# EasyEDA Pro project ca_car.eprj, board ca_pcb
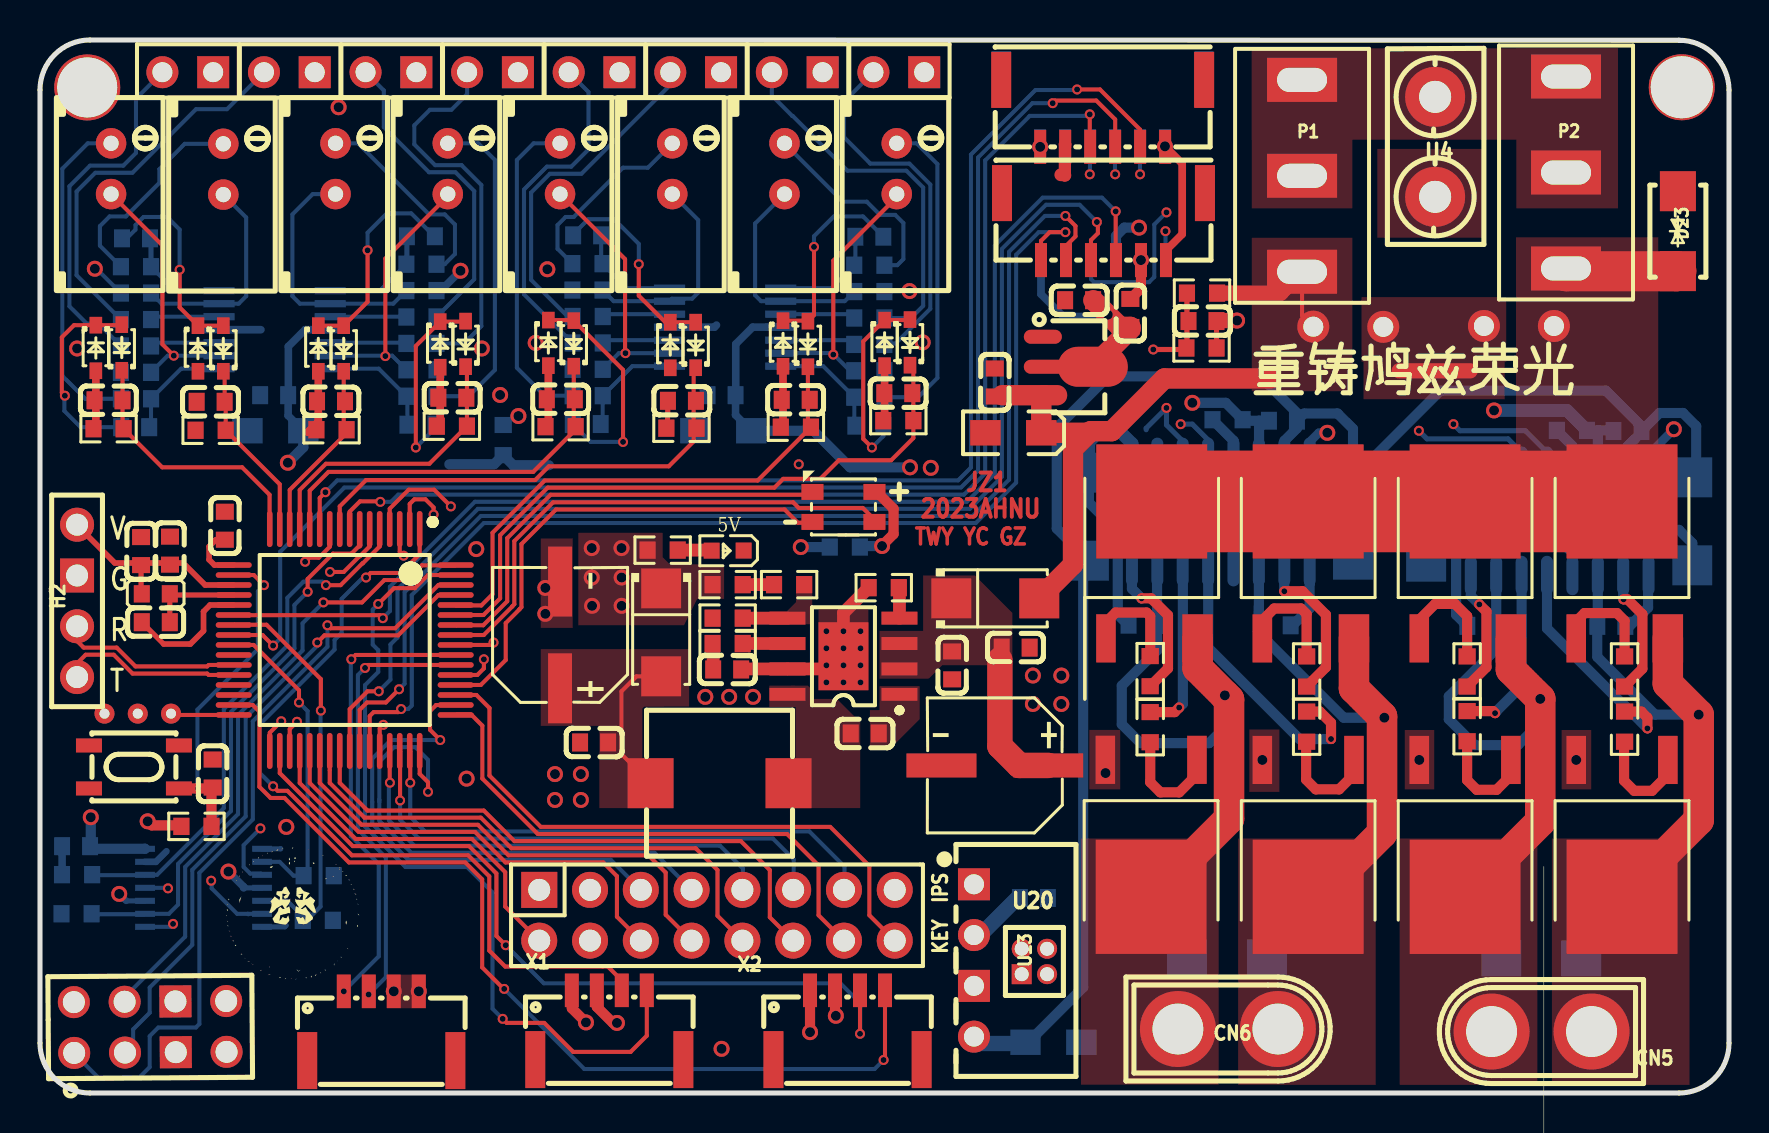
[diagram p0: board, top side]
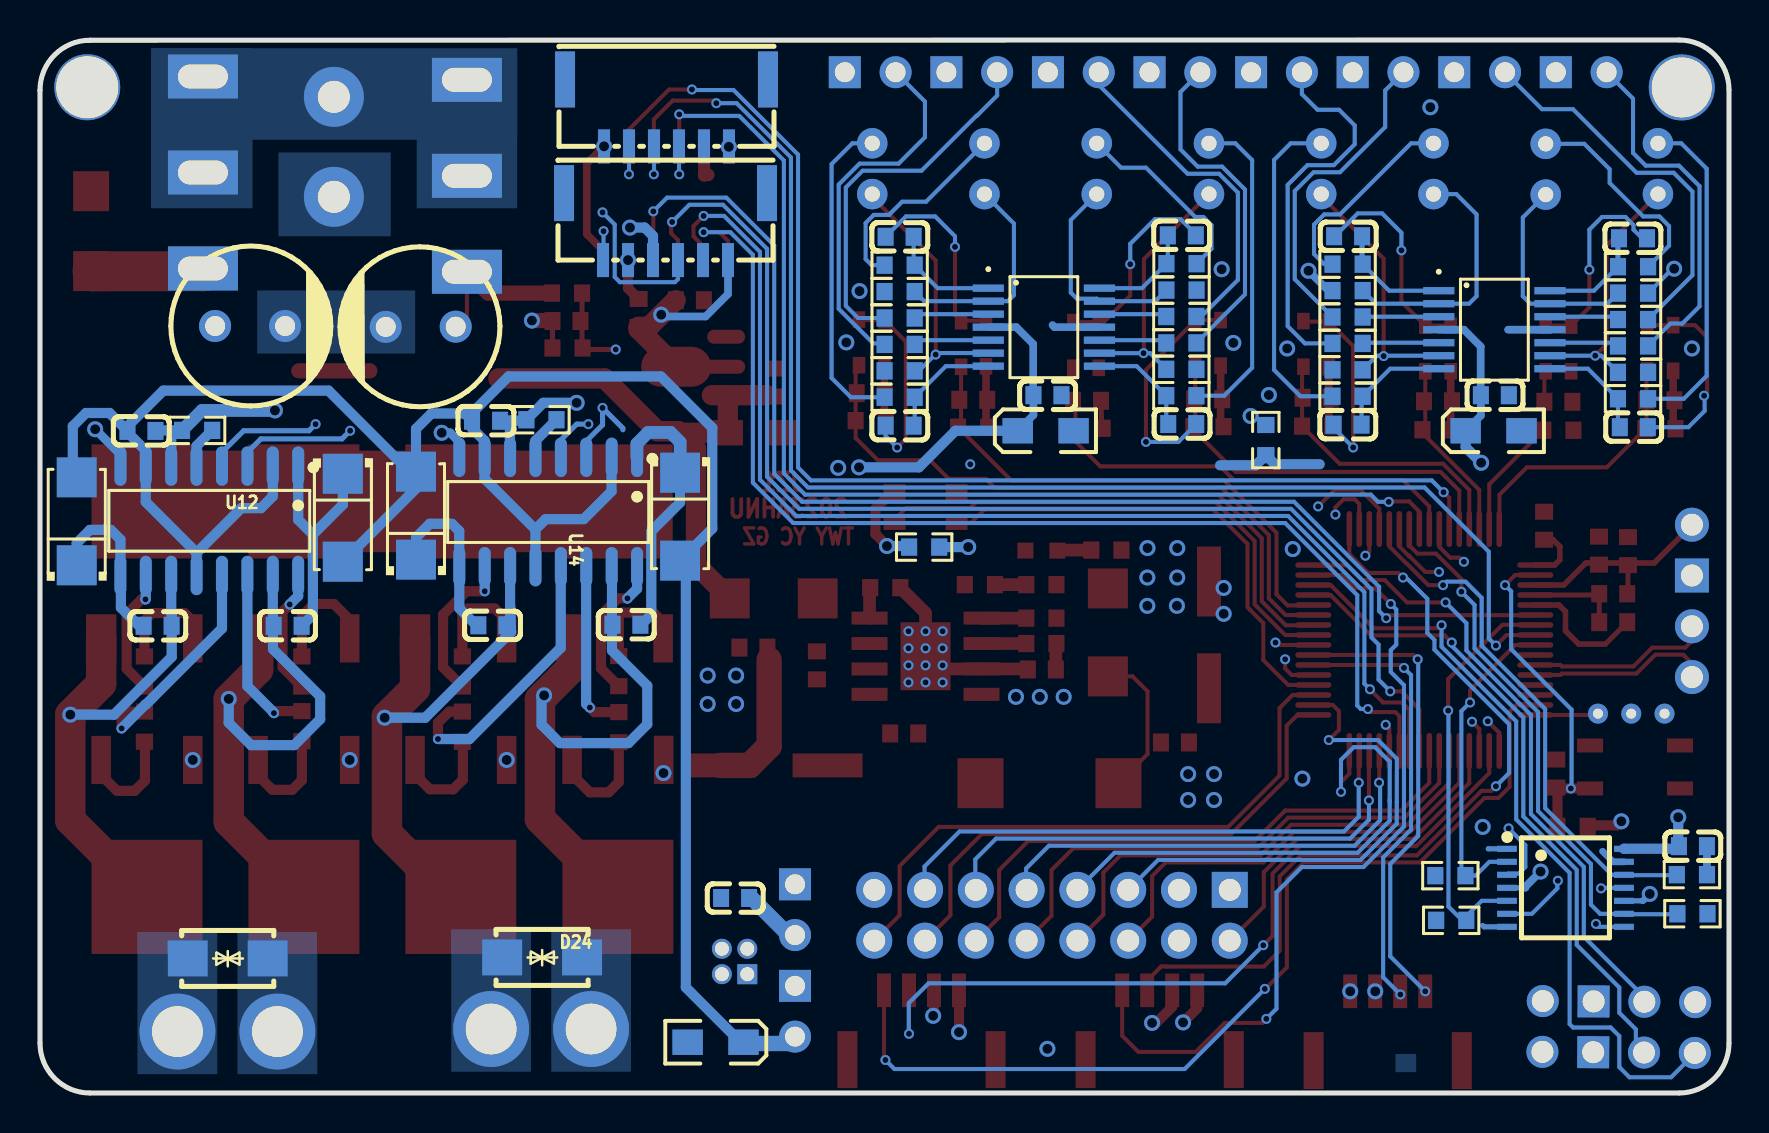
[diagram p1: board, bottom side, seen from below]

Outline 84.47 x 52.67 mm; copper layers: Top Layer, 地1, 信号, 电源, 地2, Bottom Layer. Coordinates in mm from the lower left corner of the outline.
Outline path: 0,50.17 0,2.5 arc(0.73,0.73) 2.5,0 81.97,0 arc(83.74,0.73) 84.47,2.5 84.47,50.15 arc(83.74,51.92) 81.97,52.65 2.5,52.67 arc(0.73,51.93) 0,50.17
Stack: Top Layer 0.035mm / Dielectric1 0.274mm PP er 4.5 / 地2 0.035mm / Dielectric2 0.274mm PP er 4.5 / 地1 0.035mm / Dielectric3 0.274mm FR4 er 4.5 / 信号 0.035mm / Dielectric4 0.274mm PP er 4.5 / 电源 0.035mm / Dielectric5 0.274mm PP er 4.5 / Bottom Layer 0.035mm

## Design rules (mm)
net RX: DP1
net TX: DP1
spacing safeClearance (default): track to track 0.152, other pairs 0 to 0.3
track width trackWidth (default): min 0.127, default 0.254, max 5.08
differential pair differentialPair (default): width min 0.127, default 0.254, max 2.54; gap min 0.152, default 0.152
via viaSize (default): diameter min 0.5, default 0.61, max 10; hole min 0.3, default 0.305, max 6

## Placement (name value [footprint] x y rotation side)
C1  -  [C0603]  14.55 34.6 0 top
C2  -  [C0603]  8.53 34.57 0 top
C3  -  [C0603]  19.05 42.85 0 bottom
C4  -  [C0603]  4.8 42.75 180 bottom
C5  -  [C0603]  58.14 38.61 0 top
C6  -  [C0603]  47.75 35.53 270 top
C7  -  [C0603]  19.08 33.43 0 bottom
C8  -  [C0603]  4.76 33.3 180 bottom
C9  -  [C0603]  11.71 34.9 0 bottom
C10  10uf钽电容  [10uf]  11.79 33.38 180 bottom
C11  -  [C0603]  20.62 34.77 0 top
C12  -  [C0603]  3.43 34.65 0 top
C13  -  [C0603]  41.25 17.98 180 top
C14  -  [C0603]  37.8 34.67 0 top
C15  -  [C0603]  32.11 34.62 0 top
C16  -  [C0603]  27.71 17.53 180 top
C17  100  [CAP-SMD_BD6.3-L6.6-W6.6-LS7.2-FD-1]  26.01 22.91 90 top
C18  -  [C0603]  34.09 34.9 0 bottom
C19  10uf钽电容  [10uf]  34.19 33.38 180 bottom
C20  -  [C0603]  41.48 42.82 0 bottom
C21  -  [C0603]  27.37 42.9 180 bottom
C22  100  [CAP-SMD_BD6.3-L6.6-W6.6-LS7.2-FD-1]  47.75 16.38 180 top
C23  -  [C0603]  48.79 22.28 0 top
C24  -  [C0603]  45.62 21.39 270 top
C25  -  [C0603]  34.37 21.18 180 top
C26  -  [C0603]  41.48 33.38 0 bottom
C27  -  [C0603]  27.35 33.46 180 bottom
C28  -  [C0603]  42.93 35 0 top
C29  -  [C0603]  26.05 34.7 0 top
C30  -  [C0603]  1.8 12.34 180 bottom
C31  -  [C0603]  72.09 23.37 180 bottom
C32  -  [C0603]  78.59 23.37 0 bottom
C33  -  [C0603]  79.4 33.11 180 bottom
C34  10uf钽电容  [10uf]  50.67 2.29 0 bottom
C35  100nF  [C0603]  49.71 9.75 0 bottom
C36  -  [C0603]  55.14 23.42 180 bottom
C37  -  [C0603]  51.97 39.65 180 top
C38  -  [C0603]  61.85 23.39 0 bottom
C39  -  [C0603]  62.16 33.62 180 bottom
C40  -  [C0603]  9.25 28.37 270 top
C41  -  [C0603]  8.64 15.98 90 top
C42  -  [C0603]  5.79 23.55 0 top
C43  -  [C0603]  5.05 27.1 90 top
C44  -  [C0603]  6.5 27.13 90 top
C45  470u  [KY-电解电容直径8]  65.43 38.32 359.9 bottom
C46  470u  [KY-电解电容直径8]  73.97 38.36 180 bottom
C47  10uf钽电容  [10uf]  48.69 32.77 180 top
C48  -  [C0603]  54.53 39.01 90 top
CN1  A1257WV-S-6P  [CONN-SMD_A1257WV-S-6P]  53.15 49 180 top
CN2  A1257WV-S-6P  [CONN-SMD_A1257WV-S-6P]  53.19 43.33 180 top
CN3  A1257WV-S-6P  [CONN-SMD_A1257WV-S-6P]  53.19 43.33 0 bottom
CN4  A1257WV-S-6P  [CONN-SMD_A1257WV-S-6P]  53.14 49.02 0 bottom
CN5  XT30U-M  [CONN-TH_XT30U-M]  75.1 3.07 180 top
CN6  XT30U-M  [CONN-TH_XT30U-M]  59.41 3.2 0 top
D1  1N5819WS S4  [SOD-323_L1.7-W1.3-LS2.6-RD-1]  15.19 37.24 90 top
D2  1N5819WS S4  [SOD-323_L1.7-W1.3-LS2.6-RD-1]  9.17 37.24 90 top
D3  1N5819WS S4  [SOD-323_L1.7-W1.3-LS2.6-RD-1]  13.92 37.24 270 top
D4  1N5819WS S4  [SOD-323_L1.7-W1.3-LS2.6-RD-1]  7.9 37.24 270 top
D5  1N5819WS S4  [SOD-323_L1.7-W1.3-LS2.6-RD-1]  20.02 37.44 270 top
D6  1N5819WS S4  [SOD-323_L1.7-W1.3-LS2.6-RD-1]  2.79 37.26 270 top
D7  1N5819WS S4  [SOD-323_L1.7-W1.3-LS2.6-RD-1]  21.29 37.47 90 top
D8  1N5819WS S4  [SOD-323_L1.7-W1.3-LS2.6-RD-1]  4.09 37.29 90 top
D9  ss54  [SMA_L4.3-W2.6-LS5.1-RD]  31.06 23.04 270 top
D10  ss54  [SMA_L4.3-W2.6-LS5.1-RD]  47.78 24.74 0 top
D11  1N5819WS S4  [SOD-323_L1.7-W1.3-LS2.6-RD-1]  38.41 37.46 90 top
D12  1N5819WS S4  [SOD-323_L1.7-W1.3-LS2.6-RD-1]  32.79 37.41 90 top
D13  1N5819WS S4  [SOD-323_L1.7-W1.3-LS2.6-RD-1]  37.16 37.49 270 top
D14  1N5819WS S4  [SOD-323_L1.7-W1.3-LS2.6-RD-1]  31.52 37.41 270 top
D15  1N5819WS S4  [SOD-323_L1.7-W1.3-LS2.6-RD-1]  42.24 37.52 270 top
D16  1N5819WS S4  [SOD-323_L1.7-W1.3-LS2.6-RD-1]  25.43 37.52 270 top
D17  1N5819WS S4  [SOD-323_L1.7-W1.3-LS2.6-RD-1]  43.51 37.54 90 top
D18  1N5819WS S4  [SOD-323_L1.7-W1.3-LS2.6-RD-1]  26.7 37.49 90 top
D19  SS14  [SMA_L4.3-W2.6-LS5.1-RD]  69.32 28.77 270 bottom
D20  -  [SMA_L4.3-W2.5-LS5.0-BI]  75.08 6.73 0 bottom
D21  SS14  [SMA_L4.3-W2.6-LS5.1-RD]  82.63 28.59 90 bottom
D22  SS14  [SMA_L4.3-W2.6-LS5.1-RD]  52.46 28.82 270 bottom
D23  -  [SMA_L4.3-W2.5-LS5.0-BI]  81.91 43.1 90 top
D24  -  [SMA_L4.3-W2.5-LS5.0-BI]  59.36 6.78 0 bottom
D25  SS14  [SMA_L4.3-W2.6-LS5.1-RD]  65.67 28.87 90 bottom
H2  -  [HDR-TH_4P-P2.54-V-F]  1.85 24.61 270 top
H3  -  [HDR-TH_16P-P2.54-V-F]  25.17 51.05 0 top
H4  -  [HDR-TH_8P-P2.54-V-F-R2-C4-S2.54-1]  5.51 3.3 0.4 top
K1  -  [按键]  4.7 18.09 180 top
L1  4,7uh  [IND-SMD_L7.3-W7.3]  33.99 15.49 180 top
LED1  LTST-N683EGBW  [LED-SMD_4P-L3.2-W2.8-P1.50-LS3.5-TL_LTST-N683EGBW]  40.18 29.31 0 top
LED2  -  [LED0603-RD_BLUE]  34.39 27.13 180 top
NOREF  -  [Pad_e1501]  82.11 50.3 270 top
NOREF#2  -  [Pad_e3658]  6.55 18.97 0 top
NOREF#3  -  [Pad_e8166]  4.89 18.97 0 top
NOREF#4  -  [Pad_e1499]  2.36 50.29 0 top
NOREF#5  -  [Pad_e8167]  3.23 18.97 0 top
P1  -  [扭子开关]  63.05 46.02 180 top
P2  -  [扭子开关]  76.39 45.89 0 top
Q1  LR7843  [TO-252-2_L6.6-W6.1-P4.58-LS9.9-BR]  71.27 26.16 270 top
Q2  LR7843  [TO-252-2_L6.6-W6.1-P4.58-LS9.9-BR]  79.12 26.16 270 top
Q3  LR7843  [TO-252-2_L6.6-W6.1-P4.58-LS9.9-BR#2]  71.27 13.23 90 top
Q4  LR7843  [TO-252-2_L6.6-W6.1-P4.58-LS9.9-BR#2]  79.12 13.23 90 top
Q5  LR7843  [TO-252-2_L6.6-W6.1-P4.58-LS9.9-BR]  55.6 26.16 270 top
Q6  LR7843  [TO-252-2_L6.6-W6.1-P4.58-LS9.9-BR]  63.42 26.16 270 top
Q7  LR7843  [TO-252-2_L6.6-W6.1-P4.58-LS9.9-BR#2]  55.57 13.24 90 top
Q8  LR7843  [TO-252-2_L6.6-W6.1-P4.58-LS9.9-BR#2]  63.42 13.23 90 top
R1  -  [R0603]  14.58 33.17 0 top
R2  -  [R0603]  8.53 33.15 0 top
R3  -  [R0603]  19.08 41.45 180 bottom
R4  -  [R0603]  4.8 41.33 0 bottom
R5  -  [R0603]  19.08 40.13 0 bottom
R6  -  [R0603]  19.08 38.81 0 bottom
R7  -  [R0603]  4.8 38.68 180 bottom
R8  -  [R0603]  4.8 40.01 180 bottom
R10  -  [R0603]  58.12 40.01 180 top
R11  -  [R0603]  58.09 37.26 0 top
R12  -  [R0603]  19.08 36.17 0 bottom
R13  -  [R0603]  19.08 37.49 0 bottom
R14  -  [R0603]  4.8 37.36 180 bottom
R15  -  [R0603]  4.8 36.04 180 bottom
R16  -  [R0603]  19.08 34.85 180 bottom
R17  -  [R0603]  4.8 34.72 0 bottom
R18  -  [R0603]  20.6 33.35 0 top
R19  -  [R0603]  3.43 33.22 0 top
R20  -  [R0603]  40.25 27.31 180 bottom
R21  -  [R0603]  34.39 25.43 0 top
R22  -  [R0603]  31.14 27.15 0 top
R23  -  [R0603]  37.8 33.3 0 top
R24  -  [R0603]  32.08 33.25 0 top
R25  -  [R0603]  37.47 25.43 0 top
R26  -  [R0603]  41.48 41.4 180 bottom
R27  -  [R0603]  27.38 41.48 0 bottom
R28  -  [R0603]  42.2 25.27 0 top
R29  10K  [R0603]  34.39 23.75 180 top
R30  -  [R0603]  34.39 22.48 0 top
R31  -  [R0603]  41.48 40.08 0 bottom
R32  -  [R0603]  41.48 38.76 0 bottom
R33  -  [R0603]  27.39 38.84 180 bottom
R34  -  [R0603]  27.38 40.16 180 bottom
R35  -  [R0603]  41.48 36.12 0 bottom
R36  -  [R0603]  41.48 37.44 0 bottom
R37  -  [R0603]  27.39 37.52 180 bottom
R38  -  [R0603]  23.17 32.66 90 bottom
R39  -  [R0603]  27.39 36.2 180 bottom
R40  -  [R0603]  41.48 34.8 180 bottom
R41  -  [R0603]  27.39 34.87 0 bottom
R42  -  [R0603]  42.93 33.63 0 top
R43  -  [R0603]  26.04 33.33 0 top
R44  -  [R0603]  71.37 21.08 90 top
R45  -  [R0603]  79.25 21.08 270 top
R46  10K  [R0603]  13.89 8.64 0 bottom
R47  10K  [R0603]  1.85 10.92 0 bottom
R48  -  [R0603]  71.37 18.35 270 top
R49  -  [R0603]  79.25 18.32 90 top
R50  10K  [R0603]  13.94 10.87 0 bottom
R51  10K  [R0603]  1.83 8.97 0 bottom
R52  10K  [R0603]  76.61 33.14 0 bottom
R53  -  [R0603]  55.52 21.1 90 top
R54  -  [R0603]  63.35 21.08 270 top
R55  -  [R0603]  55.52 18.3 270 top
R56  -  [R0603]  63.35 18.32 90 top
R57  10K  [R0603]  7.82 13.34 0 top
R58  10K  [R0603]  59.39 33.67 0 bottom
U4  -  [端子]  68.12 136.86 90 top
U5  -  [TSSOP-14_L4.9-W4.4-P0.65-LS6.4-BL]  11.73 38.18 270 bottom
U7  SP1N28STER  [SOP-8E]  40.18 21.84 180 top
U8  -  [TSSOP-14_L4.9-W4.4-P0.65-LS6.4-BL]  34.26 38.3 270 bottom
U10  -  [LQFP-64_L10.0-W10.0-P0.50-LS12.0-TL]  15.24 22.66 270 top
U11  -  [TSSOP-14_L5.0-W4.4-P0.65-LS6.5-BL]  8.18 10.26 270 bottom
U12  HIP4082IBZ  [SOIC-16_L9.9-W3.9-P1.27-LS6.0-BL]  76 28.62 0 bottom
U13  -  [PWRM-TH_BXXXXS-1W]  46.71 6.63 270 top
U14  HIP4082IBZ  [SOIC-16_L9.9-W3.9-P1.27-LS6.0-BL]  59.06 29.06 0 bottom
U17  磁珠  [L0603]  5.79 24.97 0 top
U19  AMS1117S-3.3  [SOT-89-3_L4.5-W2.5-P1.50-LS4.1-BR]  51.4 36.32 180 top
U20  -  [1.27_4p_2x2]  49.61 7.09 0 top
VR1  100K  [电位器]  15.77 46.1 0 top
VR2  100K  [电位器]  10.16 46.08 0 top
VR3  100K  [电位器]  21.39 46.1 0 top
VR4  100K  [电位器]  4.55 46.1 0 top
VR5  100K  [电位器]  38.23 46.1 0 top
VR6  100K  [电位器]  32.61 46.1 0 top
VR7  100K  [电位器]  43.84 46.1 0 top
VR8  100K  [电位器]  27 46.1 0 top
X1  GH125-S04CCA-00  [CONN-SMD_4P-P1.25_JS_GH125-S04CCA-00]  28.47 3.4 0 top
X2  GH125-S04CCA-00  [CONN-SMD_4P-P1.25_JS_GH125-S04CCA-00]  40.39 3.4 0 top
X3  GH125-S04CCA-00  [CONN-SMD_4P-P1.25_JS_GH125-S04CCA-00]  17.07 3.35 0 top
屏幕  -  [HDR-TH_16P-P2.54-V-F-R2-C8-S2.54-1]  34.37 6.86 0 top

## Footprints (pads in the part's own frame, mm; a bottom-side part is the same pattern mirrored in y, then rotated)
1.27_4p_2x2
  round 1 hole 0.7: 1(-0.508,0.127) 2(0.762,0.127) 4(0.762,-1.143)
  rect 1x1 hole 0.7: 3(-0.508,-1.143)
10uf
  rect 1.524x1.27 smd: 1(-1.385,-0.254) 2(1.409,-0.254)
C0603
  rect 0.8x0.9 smd: 1(-0.7,0) 2(0.7,0)
CAP-SMD_BD6.3-L6.6-W6.6-LS7.2-FD-1
  rect 3.5x1.199 smd: 1(-2.67,0) 2(2.67,0)
CONN-SMD_4P-P1.25_JS_GH125-S04CCA-00
  rect 0.7x1.68 smd: 1(-1.875,1.732) 2(-0.625,1.732) 3(0.625,1.732) 4(1.875,1.732)
  rect 1x2.85 smd: 5(3.705,-1.732) 6(-3.705,-1.732)
CONN-SMD_A1257WV-S-6P
  rect 0.6x1.7 smd: 1(3.125,1.675) 2(1.875,1.675) 3(0.625,1.675) 4(-0.625,1.675) 5(-1.875,1.675) 6(-3.125,1.675)
  rect 1x2.8 smd: 7(5.075,-1.675) 8(-5.075,-1.675)
CONN-TH_XT30U-M
  round 3.8 hole 2.54: 1(-2.5,0) 2(2.5,0)
HDR-TH_4P-P2.54-V-F
  round 1.7 hole 1.1: 1(-3.81,0) 3(1.27,0) 4(3.81,0)
  rect 1.7x1.7 hole 1.1: 2(-1.27,0)
HDR-TH_8P-P2.54-V-F-R2-C4-S2.54-1
  round 1.6 hole 1.1: 1(-3.81,-1.27) 2(-3.81,1.27) 3(-1.27,-1.27) 4(-1.27,1.27) 7(3.81,-1.27) 8(3.81,1.27)
  rect 1.6x1.6 hole 1.1: 5(1.27,-1.27) 6(1.27,1.27)
HDR-TH_16P-P2.54-V-F
  round 1.6 hole 1: 1(-19.05,0) 3(-13.97,0) 5(-8.89,0) 7(-3.81,0) 9(1.27,0) 11(6.35,0) 13(11.43,0) 15(16.51,0)
  rect 1.6x1.6 hole 1: 2(-16.51,0) 4(-11.43,0) 6(-6.35,0) 8(-1.27,0) 10(3.81,0) 12(8.89,0) 14(13.97,0) 16(19.05,0)
HDR-TH_16P-P2.54-V-F-R2-C8-S2.54-1
  round 1.8 hole 1.1: 1(8.382,3.302) 2(8.382,0.762) 3(5.842,3.302) 4(5.842,0.762) 5(3.302,3.302) 6(3.302,0.762) 7(0.762,3.302) 8(0.762,0.762) 9(-1.778,3.302) 10(-1.778,0.762) 11(-4.318,3.302) 12(-4.318,0.762) 13(-6.858,3.302) 14(-6.858,0.762) 16(-9.398,0.762)
  rect 1.8x1.8 hole 1.1: 15(-9.398,3.302)
IND-SMD_L7.3-W7.3
  rect 2.301x2.499 smd: 1(-3.45,0) 2(3.45,0)
KY-电解电容直径8
  round 1.6 hole 1: 1(-1.75,0) 2(1.75,0)
L0603
  rect 0.8x0.864 smd: 1(-0.7,0) 2(0.7,0)
LED0603-RD_BLUE
  rect 0.8x0.8 smd: 1(-0.8,-0.003) 2(0.8,0.003)
LED-SMD_4P-L3.2-W2.8-P1.50-LS3.5-TL_LTST-N683EGBW
  rect 1.1x0.8 smd: 1(-1.55,0.75) 2(1.55,0.75) 3(1.55,-0.75) 4(-1.55,-0.75)
LQFP-64_L10.0-W10.0-P0.50-LS12.0-TL
  oval 1.801x0.28 smd: 1(-5.55,3.749) 2(-5.55,3.251) 3(-5.55,2.751) 4(-5.55,2.251) 5(-5.55,1.75) 6(-5.55,1.25) 7(-5.55,0.75) 8(-5.55,0.249) 9(-5.55,-0.249) 10(-5.55,-0.75) 11(-5.55,-1.25) 12(-5.55,-1.75) 13(-5.55,-2.251) 14(-5.55,-2.751) 15(-5.55,-3.248) 16(-5.55,-3.749) 33(5.55,-3.749) 34(5.55,-3.248) 35(5.55,-2.751) 36(5.55,-2.251) 37(5.55,-1.75) 38(5.55,-1.25) 39(5.55,-0.75) 40(5.55,-0.249) 41(5.55,0.249) 42(5.55,0.75) 43(5.55,1.25) 44(5.55,1.75) 45(5.55,2.251) 46(5.55,2.751) 47(5.55,3.251) 48(5.55,3.749)
  oval 0.28x1.801 smd: 17(-3.749,-5.55) 18(-3.248,-5.55) 19(-2.751,-5.55) 20(-2.251,-5.55) 21(-1.75,-5.55) 22(-1.25,-5.55) 23(-0.75,-5.55) 24(-0.249,-5.55) 25(0.249,-5.55) 26(0.75,-5.55) 27(1.25,-5.55) 28(1.75,-5.55) 29(2.251,-5.55) 30(2.751,-5.55) 31(3.251,-5.55) 32(3.749,-5.55) 49(3.749,5.55) 50(3.251,5.55) 51(2.751,5.55) 52(2.251,5.55) 53(1.75,5.55) 54(1.25,5.55) 55(0.75,5.55) 56(0.249,5.55) 57(-0.249,5.55) 58(-0.75,5.55) 59(-1.25,5.55) 60(-1.75,5.55) 61(-2.251,5.55) 62(-2.751,5.55) 63(-3.248,5.55) 64(-3.749,5.55)
Pad_e1499
  round 3.3 hole 3: 1(0,0)
Pad_e1501
  round 3.3 hole 3.1: 2(0,0)
Pad_e3658
  round 1 hole 0.5: 1(0,0)
Pad_e8166
  round 1 hole 0.5: 2(0,0)
Pad_e8167
  round 1 hole 0.5: 3(0,0)
PWRM-TH_BXXXXS-1W
  rect 1.6x1.6 hole 1: 1(-3.81,0) 3(1.27,0)
  round 1.6 hole 1: 2(-1.27,0) 4(3.81,0)
R0603
  rect 0.806x0.864 smd: 1(-0.753,0) 2(0.753,0)
SMA_L4.3-W2.5-LS5.0-BI
  rect 1.999x1.801 smd: 1(-1.999,0) 2(1.999,0)
SMA_L4.3-W2.6-LS5.1-RD
  rect 1.999x1.999 smd: 1(-2.2,0) 2(2.2,0)
SOD-323_L1.7-W1.3-LS2.6-RD-1
  rect 0.83x0.63 smd: 1(-1.14,0) 2(1.14,0)
SOIC-16_L9.9-W3.9-P1.27-LS6.0-BL
  oval 0.602x1.971 smd: 1(-4.445,-2.736) 2(-3.175,-2.736) 3(-1.905,-2.736) 4(-0.635,-2.736) 5(0.635,-2.736) 6(1.905,-2.736) 7(3.175,-2.736) 8(4.445,-2.736) 9(4.445,2.736) 10(3.175,2.736) 11(1.905,2.736) 12(0.635,2.736) 13(-0.635,2.736) 14(-1.905,2.736) 15(-3.175,2.736) 16(-4.445,2.736)
SOP-8E
  rect 2.5x3.4 smd: 0(0,0)
  rect 1.8x0.65 smd: 1(-2.8,1.905) 2(-2.8,0.635) 3(-2.8,-0.635) 4(-2.8,-1.905) 5(2.8,-1.905) 6(2.8,-0.635) 7(2.8,0.635) 8(2.8,1.905)
SOT-89-3_L4.5-W2.5-P1.50-LS4.1-BR
  oval 1.9x0.7 smd: 1(1.25,-1.501) 3(1.25,1.501)
  oval 3.5x2 smd: 2(-1.25,0)
  oval 2.1x0.7 smd: 2(1.151,0)
TO-252-2_L6.6-W6.1-P4.58-LS9.9-BR
  rect 2.408x0.978 smd: 1(3.424,-2.291)
  rect 5.71x5.548 smd: 2(-3.424,0)
  rect 2.408x1.524 smd: 3(3.424,2.291)
TO-252-2_L6.6-W6.1-P4.58-LS9.9-BR#2
  rect 2.408x0.978 smd: 1(3.424,-2.291) 3(3.424,2.291)
  rect 5.71x5.548 smd: 2(-3.424,0)
TSSOP-14_L4.9-W4.4-P0.65-LS6.4-BL
  rect 0.364x1.56 smd: 1(-1.95,-2.78) 2(-1.3,-2.78) 3(-0.65,-2.78) 4(0,-2.78) 5(0.65,-2.78) 6(1.3,-2.78) 7(1.95,-2.78) 8(1.95,2.78) 9(1.3,2.78) 10(0.65,2.78) 11(0,2.78) 12(-0.65,2.78) 13(-1.3,2.78) 14(-1.95,2.78)
TSSOP-14_L5.0-W4.4-P0.65-LS6.5-BL
  rect 0.305x0.991 smd: 1(-1.95,-2.926) 2(-1.3,-2.926) 3(-0.65,-2.926) 4(0,-2.926) 5(0.65,-2.926) 6(1.3,-2.926) 7(1.95,-2.926) 8(1.95,2.926) 9(1.3,2.926) 10(0.65,2.926) 11(0,2.926) 12(-0.65,2.926) 13(-1.3,2.926) 14(-1.95,2.926)
扭子开关
  rect 3.5x2.2 hole 2.5x1.2: 1(-0.069,0.15) 2(-0.069,-4.65) 3(-0.069,4.95)
按键
  rect 1.3x0.7 smd: 1(-2.25,0.703) 2(-2.25,2.853) 11(2.25,0.703) 22(2.25,2.853)
电位器
  round 1.524 hole 0.762: 1(-0.992,1.397) 2(-0.992,-1.143)
端子
  round 3 hole 1.6: 1(-92.035,-1.651) 2(-87.035,-1.651)

## Nets
+5V: C9.2 C10.1 C18.2 C19.1 C30.1 C35.1 C43.1 C44.1 CN1.1 CN1.6 CN2.6 CN3.3 CN4.1 CN4.6 D9.1 H2.1 H4.7 R20.2 R21.1 R22.1 R57.1 U5.4 U8.4 U10.19 U11.14 U13.2 U17.1 U20.1 X1.1 X2.1 X3.3 X3.4 屏幕.13 屏幕.14
+5VS: C37.1 C48.1 CN3.6 U19.2
+12V: C33.1 C34.1 C39.1 D19.2 D21.2 D22.2 D25.2 U12.2 U12.7 U12.12 U13.4 U14.2 U14.7 U14.12
AGND: C1.1 C2.1 C9.1 C10.2 C11.1 C12.1 C14.1 C15.1 C18.1 C19.2 C28.1 C29.1 D3.2 D4.2 D5.2 D6.2 D13.2 D14.2 D15.2 D16.2 H3.2 H3.4 H3.6 H3.8 H3.10 H3.12 H3.14 H3.16 R1.1 R2.1 R5.2 R8.2 R12.2 R15.2 R18.1 R19.1 R23.1 R24.1 R31.2 R34.2 R35.2 R38.2 R39.2 R42.1 R43.1 U5.11 U8.11
GND: C5.2 C6.1 C16.2 C17.2 C22.2 C23.2 C24.2 C25.1 C30.2 C33.2 C34.2 C35.2 C37.2 C39.2 C40.1 C41.2 C42.1 C43.2 C44.2 C45.2 C46.2 C47.2 C48.2 CN1.2 CN2.5 CN3.2 CN3.5 CN4.5 D23.2 H2.2 H4.5 H4.6 K1.1 LED2.1 Q3.3 Q4.3 Q7.3 Q8.3 R11.2 R28.1 R29.2 R38.1 R46.2 R47.1 R50.2 R51.1 R52.2 R58.2 U4.1 U7.0 U7.7 U10.21 U11.1 U11.4 U11.7 U11.10 U11.13 U12.6 U12.8 U13.1 U13.3 U14.6 U14.8 U19.1 U20.2 X1.2 X2.2 屏幕.15
VCC: C6.2 C45.1 C47.1 D10.2 P1.3 R10.1 U19.3
VCCBAT: P1.1 P1.2 P2.1 P2.3 U4.2
VCCMOTOR: C46.1 D23.1 P2.2 Q1.2 Q2.2 Q5.2 Q6.2
ADC_DIS1: U10.2 U20.3
ADC_DIS2: U10.4 U20.4
ADC_P00: C28.2 D17.1 R42.2 U10.59
ADC_P01: C14.2 D11.1 R23.2 U10.60
ADC_P10: C15.2 D12.1 R24.2 U10.9
ADC_P13: C12.2 D8.1 R19.2 U10.16
ADC_P14: C29.2 D18.1 R43.2 U10.12
ADC_P15: C11.2 D7.1 R18.2 U10.13
ADC_P16: C1.2 D1.1 R1.2 U10.14
ADC_P17: C2.2 D2.1 R2.2 U10.15
ADCBAT: C5.1 R10.2 R11.1 U10.3
ADCIN1: H3.5 R6.2
ADCIN2: H3.3 R7.2
ADCIN3: H3.7 R13.2
ADCIN4: H3.1 R14.2
ADCIN5: H3.13 R32.2
ADCIN6: H3.11 R33.2
ADCIN7: H3.15 R36.2
ADCIN8: H3.9 R37.2
CNT_P04: U10.63 X1.4
CNT_P34: U10.31 X2.4
CS: CN2.1 U10.43
CS_P22: U10.47 屏幕.3
DC_P21: U10.46 屏幕.5
DIR_P35: U10.34 X2.3
DIR_P53: U10.1 X1.3
K1: U10.37 屏幕.12
K2: U10.38 屏幕.10
K3: U10.39 屏幕.8
K4: U10.40 屏幕.6
K5: U10.36 屏幕.16
LED1: LED1.1 U10.58
LED2: LED1.3 U10.57
LED3: LED1.4 U10.52
MISO: CN2.2 U10.42
MOSI: CN2.3 U10.41
MOTOR1+: C31.1 CN5.2 D20.1 Q1.3 Q3.2 U12.15
MOTOR1-: C32.1 CN5.1 D20.2 Q2.3 Q4.2 U12.11
MOTOR2+: C36.1 CN6.1 D24.1 Q5.3 Q7.2 U14.15
MOTOR2-: C38.1 CN6.2 D24.2 Q6.3 Q8.2 U14.11
P11: NOREF#5.3 U10.10
P36: CN4.3 U10.35
P44: CN4.2 U10.44
P50: NOREF#2.1 U10.32
P51: CN4.4 U10.33
P61: NOREF#3.2 U10.6
P67: U10.26
PWM1: U10.55 X3.1
PWM2: U10.54 X3.2
PWM3: CN3.4 U10.53
PWM4: CN3.1 U10.56
PWMA_I: R47.2 U10.5 U11.12
PWMA_O: U11.11 U12.3
PWMB_I: R51.2 U10.7 U11.9
PWMB_O: U11.8 U12.4
PWMC_I: R50.1 U10.25 U11.2
PWMC_O: U11.3 U14.3
PWMD_0: U11.6 U14.4
PWMD_I: R46.1 U10.23 U11.5
RST_52: H4.4 U10.64
RST_P20: U10.45 屏幕.7
RX: H2.3 U10.27
RX_P02: H4.3 U10.61
SCK: CN2.4 U10.22
SCL_P25: U10.50 屏幕.11
SDA_P23: U10.48 屏幕.9
SW1: U10.49 屏幕.4
SW2: U10.51 屏幕.2
TOF_SCL: CN1.3 U10.8
TOF_SDA: CN1.4 U10.24
TOF_XS: CN1.5 U10.11
TX: H2.4 U10.28
TX_P03: H4.1 U10.62
$1N4829: R44.1 U12.16
$1N6782: Q1.1 R44.2
$1N6904: Q2.1 R45.1
$1N6954: C32.2 D21.1 U12.9
$1N7218: R45.2 U12.10
$1N7863: R49.2 U12.13
$1N7949: R48.1 U12.14
$1N8515: Q3.1 R48.2
$1N8874: Q4.1 R49.1
$1N11903: C31.2 D19.1 U12.1
$1N14158: R53.1 U14.16
$1N14159: Q5.1 R53.2
$1N14160: Q6.1 R54.1
$1N14162: C38.2 D25.1 U14.9
$1N14163: R55.1 U14.14
$1N14164: Q7.1 R55.2
$1N14165: Q8.1 R56.1
$1N14166: R56.2 U14.13
$1N14168: R54.2 U14.10
$1N14171: C36.2 D22.1 U14.1
$1N116715: U10.29
$1N116841: U10.30
$1N161006: LED1.2 R20.1
$1N164801: C41.1 K1.2 R57.2 U10.18
$1N166533: C40.2 U10.17
$1N172196: R52.1 U12.5
$1N173888: R58.1 U14.5
$1N187403: R3.1 VR1.1
$1N187731: R5.1 U5.2 VR1.2
$1N189829: R6.1 U5.3
$1N201850: C3.1 R3.2 U5.1
$1N279025: C42.2 U10.20 U17.2
$1N320512: C3.2 D1.2 D3.1
$1N344378: R7.1 U5.12
$1N344380: R8.1 U5.13 VR2.2
$1N344381: R4.1 VR2.1
$1N344382: C4.1 R4.2 U5.14
$1N344383: C4.2 D2.2 D4.1
$1N374790: R13.1 U5.5
$1N374792: R12.1 U5.6 VR3.2
$1N374793: R16.1 VR3.1
$1N374794: C7.1 R16.2 U5.7
$1N374795: C7.2 D5.1 D7.2
$1N374798: R14.1 U5.10
$1N374800: R15.1 U5.9 VR4.2
$1N374801: R17.1 VR4.1
$1N374802: C8.1 R17.2 U5.8
$1N374803: C8.2 D6.1 D8.2
$1N379031: R32.1 U8.3
$1N379035: R31.1 U8.2 VR5.2
$1N379036: R26.1 VR5.1
$1N379037: C20.1 R26.2 U8.1
$1N379038: C20.2 D11.2 D13.1
$1N379041: R33.1 U8.12
$1N379043: R34.1 U8.13 VR6.2
$1N379044: R27.1 VR6.1
$1N379045: C21.1 R27.2 U8.14
$1N379051: R36.1 U8.5
$1N379053: R35.1 U8.6 VR7.2
$1N379054: R40.1 VR7.1
$1N379055: C26.1 R40.2 U8.7
$1N379056: C26.2 D15.1 D17.2
$1N379059: R37.1 U8.10
$1N379061: R39.1 U8.9 VR8.2
$1N379062: R41.1 VR8.1
$1N379063: C27.1 R41.2 U8.8
$1N379064: C27.2 D16.1 D18.2
$1N379068: C21.2 D12.2 D14.1
$1N458057: C22.1 C23.1 C24.1 D10.1 U7.2 U7.3
$1N471687: R28.2 U7.4
$1N474432: C25.2 R30.1
$1N474773: R30.2 U7.6
$1N475660: C13.1 U7.1
$1N476009: C13.2 L1.1 U7.8
$1N478879: C16.1 C17.1 D9.2 L1.2
$1N485591: R21.2 R25.1
$1N487218: R25.2 R29.1 U7.5
$1N494652: LED2.2 R22.2

Pads without a net: CN1 7 8; CN2 7 8; CN3 7 8; CN4 7 8; H4 2 8; K1 11 22; NOREF 2; NOREF#4 1; X1 5 6; X2 5 6; X3 5 6; 屏幕 1

## Via types
v1: diameter 0.5, hole 0.3, Top Layer to Bottom Layer, 97 vias
v2: diameter 0.8, hole 0.5, Top Layer to Bottom Layer, 67 vias
